# EasyEDA Pro project BCI_TESTING_BOARD.eprj, board BCI_Board (continued)
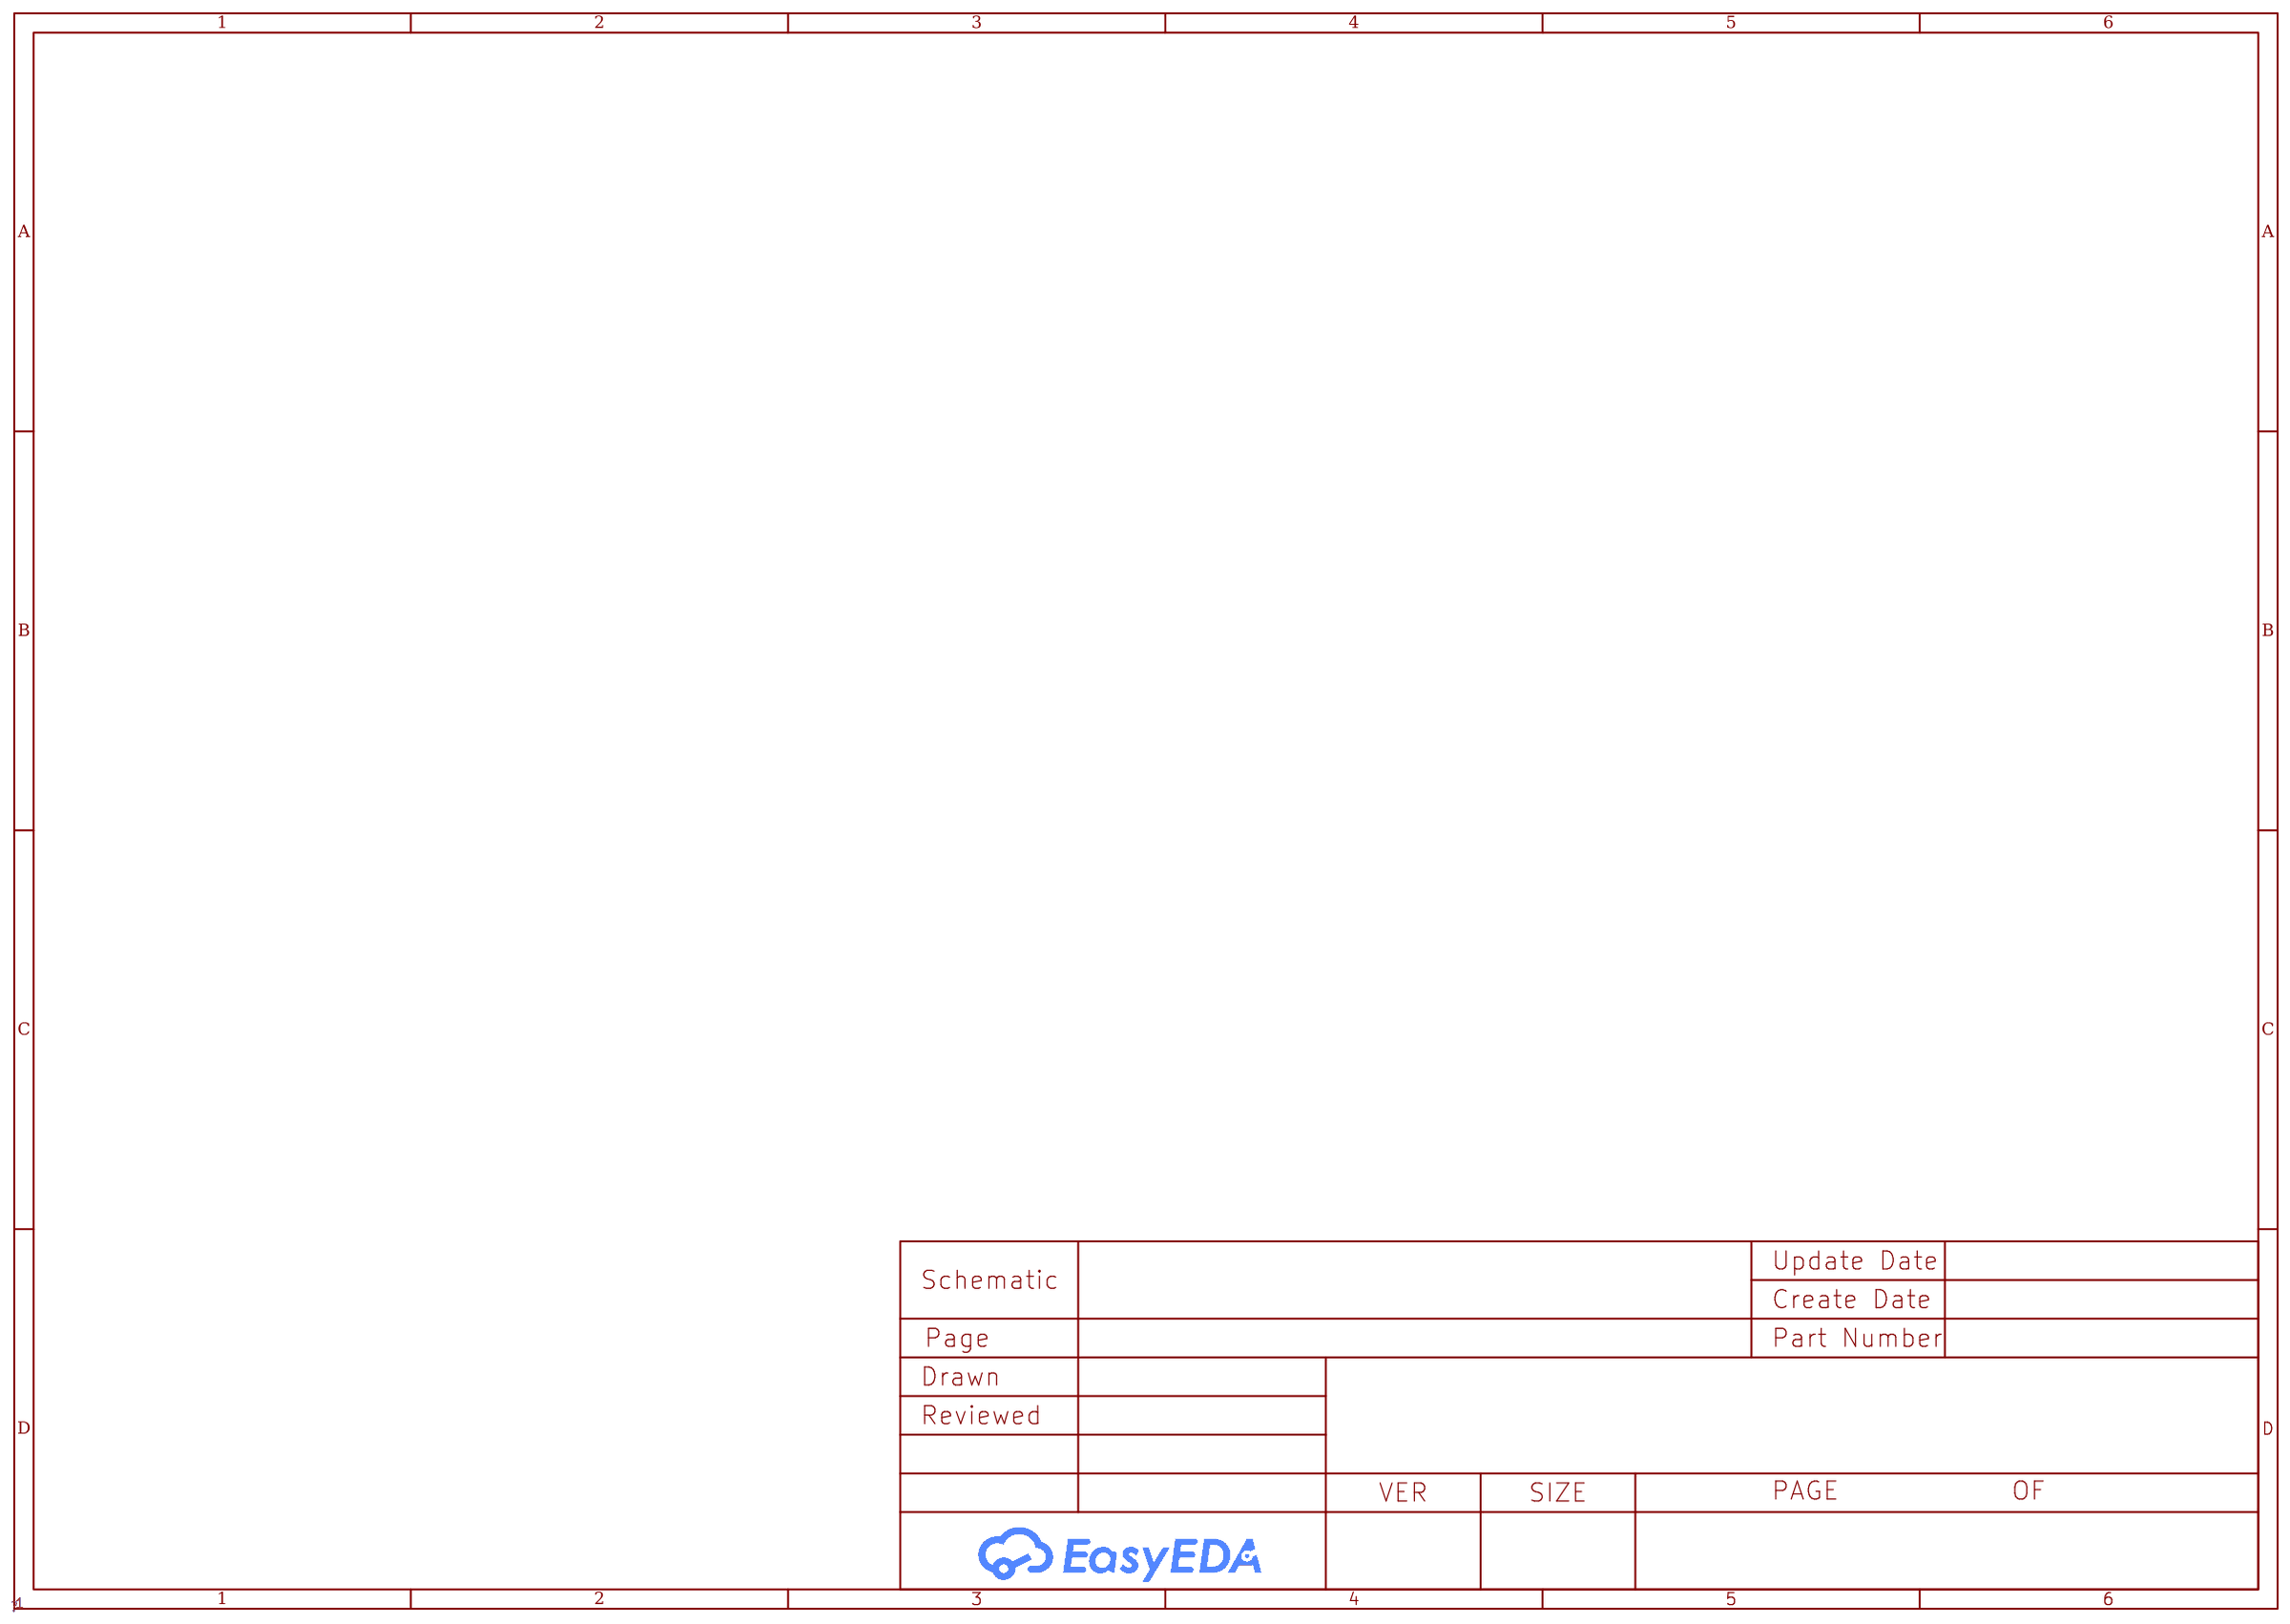
[diagram p0: ESP and Power]
## Routing (per net, layer and track width the routed paths; a pad name or vN(x,y) marks a point on that pad's centre or on a via; arc(x,y) is an arc through that point)
3V3: length 47.3
  Top Layer w0.2: v1(39.75,10.3) Rb1.1 C234.2 ; R1.1 v1(30.85,35.12) ; 30.21,39.55 30.21,38.6 30.06,38.45
  Top Layer w0.28: ADC2.50 24.55,16.72 25.17,16.1 ADC2.48 ; 25.17,37.6 ADC1.48 ; 25.17,37.6 24.55,38.22 ADC1.50 ; 25.17,37.6 24.17,37.6 23.55,38.22 ADC1.52
  Top Layer w0.8: C29.2 C222.1
  Inner2 w0.2: v1(38.8,4.45) 38.8,9.35 v1(39.75,10.3) ; v1(30.85,35.12) 30.32,35.65 28.6,35.65 28.4,35.45 26.9,35.45
  Inner2 w1.3: 27.05,38.25 26.75,37.95 26.75,16.3
  vias: v1(26.55,38.45) v1(26.6,16.95) v1(27.2,37.9) v1(27.2,16.4) v1(27.85,38.45) v1(27.85,16.95) v1(28.5,37.9) v1(38.8,3.45) v1(39.15,3.95) v1(39.5,4.45) v1(39.5,3.45)
5V: length 81.7
  Top Layer w0.28: ADC1.22 ADC1.21 19.55,29.3 19.3,29.55 18.8,29.55 18.55,29.3 ADC1.19 18.55,27.1 18.1,26.65 ; ADC2.22 ADC2.21 19.55,7.8 19.3,8.05 18.8,8.05 18.55,7.8 ADC2.19 18.55,5.6 C36.2 ; 22.9,19.55 22.9,19.35 22.55,19 ADC2.54 22.55,16.8 22.3,16.55 21.54,16.55 ; ADC2.56 21.55,16.56 21.54,16.55 ; ADC2.59 20.05,16.83 20.33,16.55 21.54,16.55 ; ADC1.56 21.55,38.05 ; 22.9,40.85 22.55,40.5 ADC1.54 22.55,38.38 22.22,38.05 20.38,38.05 20.05,38.38 ADC1.59
  Top Layer w0.8: 22.9,41.05 C26.2 v1(22.9,43.05) ; C25.2 C24.2 v1(18,24.55) ; v1(18,3.05) C40.2 18,5.05 ; 22.9,21.55 22.9,19.85
  Inner2 w2: v1(18,24.55) 19.82,22.73 21.72,22.73 v1(22.9,21.55) ; 18,3.6 18,5.85 22.9,10.75 v1(22.9,21.55) ; v1(22.9,21.55) 22.9,42.4
  vias: v1(26.4,5.75) v1(26.4,5.15) v1(26.95,5.45) v1(27.5,5.75) v1(27.5,5.15)
GND:
  vias: v1(0.6,44.15) v1(0.6,42.15) v1(0.6,40.15) v1(0.6,38.15) v1(0.6,36.15) v1(0.6,34.15) v1(0.6,32.15) v1(0.6,30.15) v1(0.6,28.15) v1(0.6,26.15) v1(0.6,24.15) v1(0.6,22.15) v1(0.6,20.15) v1(0.6,18.15) v1(0.6,16.15) v1(0.6,14.15) v1(0.6,12.15) v1(0.6,10.15) v1(0.6,8.15) v1(0.6,6.15) v1(0.6,4.15) v1(0.6,2.15) v1(3.4,45.8) v1(3.35,41.85) v1(3.35,40.15) v1(3.35,37.6) v1(3.35,35.05) v1(3.35,32.5) v1(3.35,30) v1(3.35,27.45) v1(3.35,24.9) v1(3.35,22.35) v1(3.35,19.8) v1(3.35,17.3) v1(3.35,14.75) v1(3.35,12.2) v1(3.35,9.65) v1(3.35,7.1) v1(3.35,4.55) v1(3.4,0.6) v1(5.4,45.8) v1(5.4,0.6) v1(5.7,44.15) v1(5.7,39.05) v1(5.7,18.75) v1(5.7,13.65) v1(5.7,8.6) v1(5.7,3.45) v1(5.75,33.95) v1(5.75,28.85) v1(5.8,23.85) v1(5.95,1.55) v1(6.1,41.9) v1(6.1,36.75) v1(6.1,31.75) v1(6.05,26.65) v1(6.05,21.5) v1(6.1,16.45) v1(6.1,11.45) v1(6.1,6.35) v1(6.2,24.5) v1(6.25,44.6) v1(6.25,39.8) v1(6.25,34.7) v1(6.25,29.6) v1(6.25,19.41) v1(6.25,14.3) v1(6.25,9.25) v1(6.25,4.4) v1(7.4,45.8) v1(7.4,0.6) v1(7.45,21.2) v1(7.45,15.95) v1(7.45,10.85) v1(7.45,5.75) v1(8,35.95) v1(8,25.95) v1(8.2,40.65) v1(8.3,30.85) v1(9.11,22.9) v1(9.11,20.95) v1(9.11,16.55) v1(9.11,11.6) v1(9.11,7.05) v1(9.1,1.65) v1(9.4,45.8) v1(9.4,0.6) v1(9.6,21.75) v1(10.3,33.85) v1(10.3,12.35) v1(10.4,44.8) v1(11.4,45.8) v1(11.4,0.6) v1(12.02,21.95) v1(12.4,44.8) v1(12.9,43.5) v1(12.9,42.4) v1(12.9,41.3) v1(12.9,40.2) v1(12.9,39.1) v1(12.9,38) v1(12.9,36.9) v1(12.9,35.8) v1(12.9,34.7) v1(12.9,33) v1(12.9,31.9) v1(12.9,30.8) v1(12.9,29.7) v1(12.9,28.6) v1(12.9,27.5) v1(12.9,26.4) v1(12.9,25.3) v1(12.9,24.2) v1(12.9,23.1) v1(12.9,20.9) v1(12.9,19.8) v1(12.9,18.7) v1(12.9,17.6) v1(12.9,16.5) v1(12.9,15.4) v1(12.9,14.3) v1(12.9,13.2) v1(12.9,11.5) v1(12.9,10.4) v1(12.9,9.3) v1(12.9,8.2) v1(12.9,7.1) v1(12.9,6) v1(12.9,4.9) v1(12.9,3.8) v1(12.9,2.7) v1(12.9,1.6) v1(13.4,45.8) v1(13.4,44.15) v1(13.4,0.6) v1(13.85,21.95) v1(14.4,44.8) v1(14.4,42.8) v1(14.4,3.6) v1(14.4,1.6) v1(14.75,25.75) v1(14.75,23.95) v1(14.92,28.1) v1(14.95,39.2) v1(15,29.45) v1(14.95,17.7) v1(15,7.95) v1(14.95,6.6) v1(15.05,22.1) v1(15.2,20.55) v1(15.4,45.8) v1(15.4,43.8) v1(15.4,4.6) v1(15.4,2.6) v1(15.4,0.6) v1(15.95,40.2) v1(15.95,38.2) v1(15.95,18.7) v1(15.95,16.7) v1(16.3,4.4) v1(16.3,3.1) v1(16.4,44.8) v1(16.4,42.8) v1(16.4,1.6) v1(16.45,20.7) v1(16.7,23.85) v1(16.9,27.2) v1(16.9,25.9) v1(16.91,18.45) v1(16.95,39.2) v1(16.95,17.7) v1(17.15,38.05) v1(17.15,35.85) v1(17.15,33.85) v1(17.15,31.85) v1(17.4,45.8) v1(17.4,43.8) v1(17.35,22.75) v1(17.35,8.85) v1(17.4,2.25) v1(17.4,0.6) v1(17.7,16.05) v1(17.7,13.55) v1(17.7,11.35) v1(17.85,19.3) v1(18,43.2) v1(18.25,30) v1(18.4,44.8) v1(18.4,21.7) v1(18.4,1.6) v1(18.9,42.35) v1(18.95,25.9) v1(18.95,9.1) v1(19.05,37.05) v1(19.05,35.5) v1(19.05,33.95) v1(19.05,32.15) v1(19.4,45.8) v1(19.4,43.8) v1(19.4,16.5) v1(19.4,2.3) v1(19.4,0.6) v1(19.45,38.1) v1(19.65,42.35) v1(19.65,41.05) v1(19.7,25.9) v1(19.65,20.85) v1(19.65,19.55) v1(19.7,4.4) v1(19.7,3.1) v1(19.9,30.8) v1(20,10.15) v1(20.4,44.8) v1(20.4,1.6) v1(20.55,29.6) v1(20.6,24.25) v1(20.75,43.05) v1(20.75,41.7) v1(20.75,20.2) v1(20.9,15.65) v1(20.9,13.3) v1(20.9,11.05) v1(21.4,45.8) v1(21.4,43.8) v1(21.35,37.15) v1(21.35,35.75) v1(21.35,34.35) v1(21.35,32.95) v1(21.35,31.45) v1(21.4,29.75) v1(21.4,24.25) v1(21.4,2.3) v1(21.4,0.6) v1(21.55,3.05) v1(22.4,44.8) v1(22.35,3.05) v1(22.4,1.6) v1(23,8.65) v1(23.4,43.8) v1(23.4,0.6) v1(23.85,9.4) v1(23.9,8.3) v1(24.25,42.95) v1(24.35,41.7) v1(24.35,10.35) v1(24.5,30.55) v1(24.6,29.55) v1(24.55,15.25) v1(24.55,13.1) v1(24.8,8.05) v1(24.9,41.05) v1(25,31.75) v1(25,20.85) v1(25,19.55) v1(24.95,4.35) v1(25.1,36.75) v1(25.1,34.85) v1(25.1,33.05) v1(25.4,41.8) v1(25.4,12.6) v1(25.4,2.85) v1(25.4,1.35) v1(25.4,0.6) v1(25.5,39.65) v1(25.5,38.45) v1(25.5,18.25) v1(25.5,16.95) v1(25.45,11.5) v1(25.45,6.75) v1(25.6,28.45) v1(25.6,27.25) v1(25.6,25.85) v1(25.6,24.35) v1(25.6,22.85) v1(25.55,8.35) v1(25.55,7.55) v1(25.65,4.35) v1(26.2,6.75) v1(26.4,40.8) v1(26.35,4.35) v1(26.6,39.85) v1(27.1,4.35) v1(27.4,0.6) v1(27.75,3.85) v1(27.75,3.25) v1(27.75,2.55) v1(27.75,1.9) v1(27.75,1.25) v1(27.85,39.85) v1(27.85,29.75) v1(27.85,28.7) v1(27.85,25.85) v1(27.85,24.35) v1(27.85,22.85) v1(27.85,21.45) v1(27.85,20.1) v1(27.85,18.95) v1(27.85,18) v1(28.1,6.4) v1(28.25,36.1) v1(28.25,14.6) v1(28.4,9.55) v1(28.45,3.55) v1(28.45,2.9) v1(28.45,2.25) v1(28.45,1.6) v1(28.45,0.95) v1(28.55,31.15) v1(28.55,18.95) v1(28.65,28.85) v1(28.7,6.4) v1(28.75,35) v1(28.75,13.5) v1(29,27.85) v1(29.2,37.05) v1(29.3,6.4) v1(29.35,39.4) v1(29.4,15.75) v1(29.4,0.6) v1(29.45,28.35) v1(29.45,26.7) v1(29.45,24.15) v1(29.45,22.1) v1(29.45,20.1) v1(29.7,35.1) v1(29.7,33.4) v1(29.65,14.4) v1(29.7,5.85) v1(29.7,5.2) v1(29.75,31.7) v1(29.9,13.05) v1(29.85,9.95) v1(29.85,1.05) v1(30.3,5.5) v1(30.4,34.55) v1(30.35,32.7) v1(30.45,37.05) v1(30.55,30.3) v1(30.55,28.7) v1(30.55,26.65) v1(30.55,24.15) v1(30.55,22.1) v1(30.55,20.1) v1(30.55,18.35) v1(30.55,16.75) v1(30.55,15.3) v1(30.9,5.85) v1(30.9,5.15) v1(30.9,1.2) v1(30.95,11.05) v1(31.4,0.6) v1(31.5,5.5) v1(31.7,37.05) v1(31.65,32.95) v1(31.65,31.7) v1(31.65,30.8) v1(31.65,29.2) v1(31.65,27.95) v1(31.65,26.25) v1(31.65,24.15) v1(31.65,22.1) v1(31.65,20.1) v1(31.65,18.35) v1(31.65,16.75) v1(31.65,14.8) v1(31.65,13.05) v1(32.1,5.85) v1(32.1,5.2) v1(32.2,1.05) v1(32.4,10.4) v1(32.5,6.4) v1(32.75,29.05) v1(32.75,27.35) v1(32.75,25.75) v1(32.75,24.15) v1(32.75,22.1) v1(32.75,20.1) v1(32.75,18.35) v1(32.75,16.75) v1(32.75,14.2) v1(33.1,6.4) v1(33.15,40.25) v1(33.25,38.7) v1(33.35,7.55) v1(33.35,3.45) v1(33.35,2.35) v1(33.35,1.35) v1(33.4,0.6) v1(33.5,37.55) v1(33.45,34.1) v1(33.45,31.7) v1(33.6,11.6) v1(33.85,35.95) v1(34,34.75) v1(34.2,27.2) v1(34.2,26.3) v1(34.2,23.25) v1(34.2,21) v1(34.2,15.8) v1(34.2,14.1) v1(34.2,12.7) v1(34.15,10.43) v1(34.35,28.95) v1(34.4,3.45) v1(34.4,1.6) v1(34.45,2.65) v1(34.55,34.2) v1(34.9,27.9) v1(34.9,26.9) v1(35.05,31.7) v1(35.05,20.98) v1(35.15,15.8) v1(35.3,4.2) v1(35.35,23.4) v1(35.35,21.55) v1(35.4,2.6) v1(35.5,38.35) v1(35.5,36.35) v1(35.5,34.35) v1(35.5,32.95) v1(35.65,40.25) v1(35.7,22.8) v1(35.65,11.9) v1(36,23.35) v1(36,5) v1(36.05,15.8) v1(36.25,31.7) v1(36.4,2.6) v1(36.6,23.25) v1(36.55,12.8) v1(36.7,8.55) v1(36.8,26.65) v1(36.85,4.15) v1(37.4,28.95) v1(37.4,28.3) v1(37.4,2.6) v1(37.45,38.35) v1(37.45,36.35) v1(37.45,34.35) v1(37.45,32.5) v1(37.65,31.7) v1(37.65,3.35) v1(38.1,40.25) v1(38.17,8.65) v1(38.15,7.05) v1(38.4,2.6) v1(38.93,15.35) v1(39,10.6) v1(39.05,31.7) v1(39.08,13.45) v1(39.4,6.35) v1(39.4,2.6) v1(39.45,38.35) v1(39.45,36.35) v1(39.45,34.35) v1(39.45,33.25) v1(39.45,8.95) v1(39.5,5.7) v1(39.65,6.95) v1(39.8,29.2) v1(39.93,13.45) v1(39.9,5.2) v1(40.25,32.1) v1(40.3,2.6) v1(40.45,40.25) v1(40.8,6.95) v1(40.8,5.2) v1(41.1,6.3) v1(41.2,28.45) v1(41.25,17.75) v1(41.4,2.6) v1(41.45,38.35) v1(41.45,36.35) v1(41.45,34.35) v1(41.45,33.25) v1(41.5,32.15) v1(41.5,20.5) v1(41.7,9.8) v1(41.7,8.25) v1(41.7,5.2) v1(41.8,9.1) v1(42.3,8.61) v1(42.5,2.6) v1(42.7,13.9) v1(42.7,13.15) v1(42.9,37.7) v1(42.9,35.8) v1(42.9,32.9) v1(43.2,39.05) v1(43.21,31.5) v1(43.15,26.3) v1(43.5,34.05) v1(43.45,17.8) v1(43.6,2.6) v1(43.65,11.5) v1(43.75,40.25) v1(44.1,11) v1(44.2,29.2) v1(44.7,29.9) v1(44.7,26.3) v1(44.7,24.3) v1(44.7,22.3) v1(44.7,20.3) v1(44.7,17) v1(44.7,15) v1(44.7,13) v1(44.7,11) v1(44.7,9.55) v1(44.7,8.45) v1(44.7,7.35) v1(44.7,5.1) v1(44.65,2.65)
VIN: length 21.6
  Top Layer w0.2: 41.58,7.45 41.15,7.45 40.65,7.95 U14.1 ; 31.9,6.66 31.9,6.85 v1(32.15,7.1) 32.65,7.6 32.65,7.75 ; v1(42.24,20.39) 43.45,21.6 43.45,25.15 42,26.6 R_adc2.2
  Inner2 w0.2: v1(42.24,20.39) 41.84,19.99 v1(41.84,13.25) ; v1(32.15,7.1) 32.3,6.95 33.35,6.95 34.15,6.15 v1(34.15,6.1)
  vias: v1(40.94,13.25) v1(40.94,12.45) v1(41.39,12.85) v1(41.84,12.45) v1(43.25,8.2) v1(43.25,7.6) v1(43.85,8.8) v1(43.85,8.2) v1(43.85,7.6)
(no net): length 0.5
  Top Layer w0.25: ADC2.62 ADC2.63
ADC: length 11.1
  Top Layer w0.2: v1(38.45,32.1) U2.18
  Top Layer w0.5: C_adc.1 R_adc2.1 R_adc1.1 ; v1(42,29.58) 42,29.2
  Bottom Layer w0.2: v1(42,29.58) 42.65,30.23 42.65,31.85 41.8,32.7 40.65,32.7 NOREF#33.TP2 40.2,32.7 39.05,32.7 v1(38.45,32.1)
B: length 18.2
  Top Layer w0.2: 29.75,40.4 30,40.15 v1(30.3,40.15) ; U2.30 v1(43.45,35.35)
  Bottom Layer w0.2: v1(30.3,40.15) 31.15,39.3 NOREF#34.TP2 42.1,39.3 43.45,37.95 v1(43.45,35.35)
BIAS_DRV: length 6.7
  Top Layer w0.2: 11.45,43.5 11.55,43.4 11.55,43.2 11.81,42.95 13.12,42.95 15.19,40.88 15.27,40.88
  Top Layer w0.3: Cbias3.1 RBIAS4.2
  Top Layer w0.4: RBIAS5.2 CBIAS1.2
BIASINV: length 30.7
  Top Layer w0.28: RBIAS1.2 18.3,41.85 19.05,41.1 ADC1.61 ; ADC2.61 19.05,19.25 v1(18.75,19.55)
  Top Layer w0.5: 17.4,41.85 17.93,41.85
  Top Layer w0.54: v1(18.05,42.35) 18.05,41.95
  Inner2 w0.8: v1(18.05,42.35) 18.05,31.3 15.8,29.05 15.8,22.7 18.75,19.75 v1(18.75,19.55)
CLK: length 26.3
  Top Layer w0.2: 28.2,10.35 27.95,10.6 ADC2.37 ; v1(29.05,31.65) 28.6,32.1 ADC1.37
  Bottom Layer w0.2: v1(29.05,31.65) 30,30.7 30,15.55 28.2,13.75 NOREF#35.TP2
  vias: v1(28.2,10.35)
CSEL1: length 11.4
  Top Layer w0.2: v1(29,33.15) 28.95,33.1 ADC1.39 ; U2.13 v1(34.45,33.4)
  Inner2 w0.2: v1(34.45,33.4) 34.33,33.52 31.88,33.52 31.4,34 29.5,34 29,33.5 v1(29,33.15)
CSEL2: length 28.5
  Top Layer w0.2: U2.19 39.25,30.05 38.7,29.5 35.7,29.5 v1(35.19,28.99) 32.2,26 32.2,12.5 31.3,11.6 26.7,11.6
DN: length 18.2
  Top Layer w0.2: v1(43.45,32.45) 43.75,32.15 U2.26 ; USB1.5 41.2,22.6 v1(41.45,22.35) 42.1,22.35 42.4,22.65 42.4,23.4 42.1,23.7 v1(41.8,23.7) 41.7,23.6 USB1.7
  Bottom Layer w0.2: v1(41.8,23.7) 42.2,24.1 42.2,25.15 NOREF#26.TP2 42.2,25.85 42.2,28.46 43.77,30.04 43.77,31.51 43.78,31.51 43.78,32.12 v1(43.45,32.45)
DP: length 22.1
  Top Layer w0.2: U2.27 43.85,32.95 v1(43.45,33.35) ; USB1.8 41.2,24.1 v1(41.45,24.35) ; USB1.6 41.7,23.1 41.8,23
  Inner2 w0.2: v1(41.8,23) 42.15,23 42.4,23.25 42.4,24.1 42.15,24.35 v1(41.45,24.35)
  Bottom Layer w0.2: v1(43.45,33.35) 43.45,33.35 44.1,32.7 44.1,29.9 42.53,28.33 42.53,23.73 v1(41.8,23) 42.5,23 NOREF#41.TP2
G: length 6.5
  Top Layer w0.2: 38.7,28.55 38.25,28.55
  Inner2 w0.2: v1(38.7,28.55) 38.28,28.13 38.28,27.42 38.08,27.22 36.57,27.22 35.57,26.22 v1(35.57,24.67)
IN1N: length 8.1
  Top Layer w0.2: ADC1.15 14.76,30.6 14.03,29.87 14.03,27.92 13.06,26.95 11.7,26.95 11.45,26.7 11.45,26.4
  Top Layer w0.4: C102.2 R102.2
IN1N1: length 8.2
  Top Layer w0.2: 11.45,4.9 11.45,5.2 11.67,5.42 13.13,5.42 14.03,6.33 14.03,8.37 14.76,9.1 ADC2.15
  Top Layer w0.4: C202.2 R202.2
IN1P: length 8.7
  Top Layer w0.2: ADC1.16 14.72,30.1 14.36,29.73 14.36,27.15 13.09,25.88 11.73,25.88 11.45,25.6 11.45,25.3
  Top Layer w0.4: R101.2 C101.1
IN1P1: length 8.7
  Top Layer w0.2: 11.45,3.8 11.45,4.1 11.67,4.32 13.03,4.32 14.36,5.65 14.36,8.23 14.72,8.6 ADC2.16
  Top Layer w0.4: C201.1 R201.2
IN2N: length 7.2
  Top Layer w0.2: 11.45,28.6 11.45,28.9 11.7,29.15 13.06,29.15 13.38,29.47 13.38,30.14 14.84,31.6 16.05,31.6
  Top Layer w0.4: R104.2 C104.2
IN2N1: length 6.9
  Top Layer w0.2: ADC2.13 14.84,10.1 13.38,8.64 13.38,7.97 13.06,7.65 11.7,7.65 11.45,7.4 11.45,7.1
  Top Layer w0.4: C204.2 R204.2
IN2P: length 7.5
  Top Layer w0.2: ADC1.14 14.8,31.1 13.7,30 13.7,28.69 13.06,28.05 11.7,28.05 11.45,27.8 11.45,27.5
  Top Layer w0.4: R103.2 C103.1
IN2P1: length 7.5
  Top Layer w0.2: 11.45,6 11.45,6.3 11.7,6.55 13.06,6.55 13.7,7.19 13.7,8.5 14.8,9.6 ADC2.14
  Top Layer w0.4: R203.2 C203.1
IN3N: length 6.6
  Top Layer w0.2: 11.45,30.8 11.45,31.1 11.7,31.35 13.02,31.35 14.27,32.6 16.35,32.6
  Top Layer w0.4: R106.2 C106.2
IN3N1: length 6
  Top Layer w0.2: ADC2.11 14.28,11.1 13.02,9.85 11.7,9.85 11.45,9.6 11.45,9.3
  Top Layer w0.4: C206.2 R206.2
IN3P: length 6.8
  Top Layer w0.2: 16.35,32.1 14.87,32.1 13.02,30.25 11.7,30.25 11.45,30 11.45,29.7
  Top Layer w0.4: R105.2 C105.1
IN3P1: length 5.4
  Top Layer w0.2: 11.45,8.2 11.45,8.5 11.7,8.75 13.02,8.75 14.87,10.6 14.91,10.6
  Top Layer w0.4: C205.1 R205.2
IN4N: length 6.1
  Top Layer w0.2: 16.35,33.6 11.75,33.6 11.45,33.3 11.45,33
  Top Layer w0.4: R108.2 C108.2
IN4N1: length 5.5
  Top Layer w0.2: 11.45,11.5 11.45,11.8 11.75,12.1 ADC2.9
  Top Layer w0.4: R208.2 C208.2
IN4P: length 6.3
  Top Layer w0.2: 16.35,33.1 13.67,33.1 13.02,32.45 11.7,32.45 11.45,32.2 11.45,31.9
  Top Layer w0.4: R107.2 C107.1
IN4P1: length 5.7
  Top Layer w0.2: ADC2.10 13.67,11.6 13.02,10.95 11.7,10.95 11.45,10.7 11.45,10.4
  Top Layer w0.4: R207.2 C207.1
IN5N: length 5
  Top Layer w0.2: 11.45,35.8 11.45,35.5 11.7,35.25 13.02,35.25 13.67,34.6 14.97,34.6
  Top Layer w0.4: R110.2 C110.2
IN5N1: length 5.7
  Top Layer w0.2: 11.45,14.3 11.45,14 11.7,13.75 13.02,13.75 13.67,13.1 ADC2.7
  Top Layer w0.4: R210.2 C210.2
IN5P: length 6.1
  Top Layer w0.2: 11.45,34.7 11.45,34.4 11.75,34.1 16.35,34.1
  Top Layer w0.4: C109.1 R109.2
IN5P1: length 5.5
  Top Layer w0.2: 11.45,13.2 11.45,12.9 11.75,12.6 ADC2.8
  Top Layer w0.4: C209.1 R209.2
IN6N: length 6.2
  Top Layer w0.2: ADC1.5 15.74,35.61 14.87,35.61 13.02,37.45 11.7,37.45 11.45,37.7 11.45,38
  Top Layer w0.4: R112.2 C112.2
IN6N1: length 6.2
  Top Layer w0.2: 11.45,16.5 11.45,16.2 11.7,15.95 13.02,15.95 14.87,14.1 ADC2.5
  Top Layer w0.4: R212.2 C212.2
IN6P: length 5.2
  Top Layer w0.2: 11.45,36.9 11.45,36.6 11.7,36.35 13.02,36.35 14.27,35.1 14.97,35.1
  Top Layer w0.4: C111.1 R111.2
IN6P1: length 6
  Top Layer w0.2: ADC2.6 14.28,13.6 13.02,14.85 11.7,14.85 11.45,15.1 11.45,15.4
  Top Layer w0.4: R211.2 C211.1
IN7N: length 7.5
  Top Layer w0.2: ADC1.3 14.8,36.6 13.7,37.7 13.7,38.97 13.02,39.65 11.7,39.65 11.45,39.9 11.45,40.2
  Top Layer w0.4: R114.2 C114.2
IN7N1: length 7.5
  Top Layer w0.2: ADC2.3 14.8,15.1 13.7,16.2 13.7,17.51 13.06,18.15 11.7,18.15 11.45,18.4 11.45,18.7
  Top Layer w0.4: C214.2 R214.2
IN7P: length 6.9
  Top Layer w0.2: ADC1.4 14.84,36.1 13.38,37.56 13.38,38.2 13.02,38.55 11.7,38.55 11.45,38.8 11.45,39.1
  Top Layer w0.4: C113.1 R113.2
IN7P1: length 6.9
  Top Layer w0.2: ADC2.4 14.84,14.6 13.38,16.06 13.38,16.73 13.06,17.05 11.7,17.05 11.45,17.3 11.45,17.6
  Top Layer w0.4: C213.1 R213.2
IN8N: length 8.7
  Top Layer w0.2: 11.45,42.4 11.45,42.1 11.7,41.85 13.06,41.85 14.36,40.55 14.36,37.97 14.72,37.6 ADC1.1
  Top Layer w0.4: C116.2 R116.2
IN8N1: length 8.7
  Top Layer w0.2: ADC2.1 14.72,16.1 14.36,16.47 14.36,19.05 13.06,20.35 11.7,20.35 11.45,20.6 11.45,20.9
  Top Layer w0.4: C216.2 R216.2
IN8P: length 8.1
  Top Layer w0.2: 11.45,41.3 11.45,41 11.7,40.75 13.02,40.75 14.03,39.74 14.03,37.83 14.76,37.1 ADC1.2
  Top Layer w0.4: R115.2 C115.1
IN8P1: length 8.1
  Top Layer w0.2: ADC2.2 14.76,15.6 14.03,16.33 14.03,18.24 13.05,19.22 11.73,19.22 11.45,19.5 11.45,19.8
  Top Layer w0.4: R215.2 C215.1
INT: length 8.2
  Top Layer w0.2: v1(33.45,35.35) 32.55,35.35 ; ADC1.47 27.95,37.1 v1(28.25,36.8)
  Bottom Layer w0.2: v1(33.45,35.35) 32.45,36.35 28.85,36.35 28.4,36.8 v1(28.25,36.8)
MISO: length 9
  Top Layer w0.2: ADC1.43 28.05,35.1 29.1,36.15 33.15,36.15 v1(33.75,36.75)
  Bottom Layer w0.2: v1(33.75,36.75) 34.35,37.35 NOREF#10.TP2
MOSI: length 40.2
  Top Layer w0.2: ADC2.34 27.95,9.1 v1(28.2,8.85) ; v1(39.75,31.55) 40.05,31.25 40.05,30.45 ; ADC1.34 29.45,30.6 31.45,28.6 v1(32.2,28.6) ; 26.45,9.1 26.48,9.13
  Bottom Layer w0.2: 28.21,8.83 28.49,8.83 29.3,9.64 29.3,11.65 32.2,14.55 v1(32.2,28.6) 32.2,30.1 32.75,30.65 33.2,31.1 39.35,31.1 39.75,31.5 v1(39.75,31.55)
PBIAS: length 9.5
  Top Layer w0.2: RBIAS5.1 8.65,43.5 7.95,44.2 D5.1 7.95,44.97 7.67,45.25 4.57,45.25 4.57,44.79
  Top Layer w1: 4.57,44.79 2.03,44.79
PIN1N: length 10
  Top Layer w0.2: R102.1 9.87,26.37 7.95,24.45 ; 7.95,24.45 D1.1 ; 7.95,24.45 7.95,24.5 6.7,25.75 3.31,25.75 2.03,24.47
PIN1N1: length 10.1
  Top Layer w0.2: 2.03,1.66 3.22,2.85 6.9,2.85 7.3,2.45 ; D7.5 7.3,2.45 ; 7.3,2.45 7.7,2.85 8.4,2.85 9.15,3.6 9.15,4.18 R202.1
PIN1P: length 7.8
  Top Layer w0.2: 4.57,24.47 5.25,25.15 6.7,25.15 7.3,24.55 D1.2 7.3,23.75 7.57,23.48 8.2,23.48 8.4,23.68 8.4,24.12 9.58,25.3 R101.1
PIN1P1: length 7.6
  Top Layer w0.2: 4.57,1.61 4.57,1.66 5.08,2.17 D7.4 6.65,1.65 6.85,1.45 8.3,1.45 8.5,1.65 8.5,2.48 9.82,3.8
PIN2N: length 9.1
  Top Layer w0.2: 7.3,27.85 6.9,28.25 3.27,28.25 2.03,27.01 ; 7.3,27.85 D2.5 ; 7.3,27.85 7.76,28.31 9.57,28.31 R104.1
PIN2N1: length 11.6
  Top Layer w0.2: R204.1 9.87,7.02 9.32,6.47 9.32,6.19 8.88,5.75 8.6,5.75 8.28,5.43 8.28,4.18 D7.1 7.95,4.3 6.8,5.45 3.33,5.45 2.03,4.15
PIN2P: length 6.8
  Top Layer w0.2: 4.57,27.01 4.57,27.62 4.6,27.65 6.71,27.65 ; R103.1 9.22,26.85 7,26.85 6.65,27.2 D2.4
PIN2P1: length 8.8
  Top Layer w0.2: 4.57,4.15 5.47,5.05 6.5,5.05 7.3,4.25 D7.2 7.3,3.37 7.44,3.23 8.32,3.23 8.7,3.61 8.7,4.83 R203.1
PIN3N: length 9.9
  Top Layer w0.2: 7.95,29.4 7.95,29.74 6.84,30.85 3.33,30.85 2.03,29.55 ; 7.95,29.4 8.47,29.4 R106.1 ; 7.95,29.4 D2.1
PIN3N1: length 9.5
  Top Layer w0.2: 2.03,6.69 3.29,7.95 6.9,7.95 7.3,7.55 ; 7.3,7.55 7.7,7.95 8.52,7.95 R206.1 ; 7.3,7.55 D8.5
PIN3P: length 7.6
  Top Layer w0.2: 4.57,29.55 4.57,30.25 6.8,30.25 7.3,29.75 D2.2 7.3,28.85 7.52,28.63 8.8,28.63 R105.1
PIN3P1: length 7.2
  Top Layer w0.2: 4.57,6.74 4.57,6.94 4.98,7.35 6.61,7.35 ; R205.1 9.4,8.2 8.5,7.3 8.5,6.75 8.3,6.55 6.9,6.55 6.65,6.8 D8.4
PIN4N: length 9.1
  Top Layer w0.2: D3.5 7.3,32.93 ; 7.3,32.93 7.3,32.95 6.9,33.35 3.29,33.35 2.03,32.09 ; 7.3,32.93 7.72,33.35 8.6,33.35 8.95,33 R108.1
PIN4N1: length 10.7
  Top Layer w0.2: 7.95,9 7.95,9.44 6.89,10.5 3.3,10.5 2.03,9.23 ; 7.95,9 8.3,9.35 8.3,9.93 R208.1 ; 7.95,9 D8.1
PIN4P: length 6.7
  Top Layer w0.2: 4.57,32.09 4.57,32.82 4.6,32.85 6.41,32.85 6.65,32.61 6.65,32.2 6.95,31.9 R107.1
PIN4P1: length 8
  Top Layer w0.2: 4.57,9.28 5.19,9.9 6.9,9.9 7.3,9.5 D8.2 7.3,8.51 7.5,8.31 8.36,8.31 8.85,8.8 8.85,9.38 R207.1
PIN5N: length 9.6
  Top Layer w0.2: 7.95,34.7 6.8,35.85 3.25,35.85 2.03,34.63 ; 7.95,34.7 9.05,35.8 R110.1 ; 7.95,34.7 D3.1
PIN5N1: length 9.5
  Top Layer w0.2: D9.5 7.3,12.65 ; 7.3,12.65 6.9,13.05 3.31,13.05 2.03,11.77 ; 7.3,12.65 7.67,13.02 8.39,13.02 9.67,14.3 R210.1
PIN5P: length 7.5
  Top Layer w0.2: 4.57,34.63 4.57,35.12 4.8,35.35 6.8,35.35 7.3,34.85 D3.2 7.3,33.95 7.54,33.71 8.26,33.71 9.25,34.7 R109.1
PIN5P1: length 6.9
  Top Layer w0.2: 4.57,11.82 4.57,12.06 4.96,12.45 6.71,12.45 ; D9.4 6.65,11.9 6.9,11.65 8.3,11.65 9.85,13.2 R209.1
PIN6N: length 9.2
  Top Layer w0.2: 7.3,38.15 7.4,38.15 7.7,38.45 8.2,38.45 8.65,38 R112.1 ; 7.3,38.15 7.2,38.15 6.9,38.45 3.31,38.45 2.03,37.17 ; 7.3,38.15 D4.5
PIN6N1: length 10.5
  Top Layer w0.2: R212.1 8.2,14.83 8.2,14.45 7.95,14.2 D9.1 7.93,14.03 7.93,14.32 6.7,15.55 3.27,15.55 2.03,14.31
PIN6P: length 6.3
  Top Layer w0.2: 4.57,37.17 4.72,37.17 5.4,37.85 6.71,37.85 ; R111.1 7,36.9 6.65,37.25 D4.4
PIN6P1: length 8.1
  Top Layer w0.2: 4.57,14.36 4.57,14.82 4.7,14.95 6.8,14.95 7.3,14.45 D9.2 7.3,13.55 7.5,13.35 8.25,13.35 8.55,13.65 8.55,14.08 R211.1
PIN7N: length 9.6
  Top Layer w0.2: 2.03,39.71 3.27,40.95 6.95,40.95 7.95,39.95 D4.1 8.74,40.2 R114.1
PIN7N1: length 9.6
  Top Layer w0.2: 2.03,16.85 3.33,18.15 6.84,18.15 7.29,17.7 7.29,17.42 D10.5 7.3,17.75 7.6,18.05 9.22,18.05 R214.1
PIN7P: length 7
  Top Layer w0.2: R113.1 8.55,39.1 8.24,38.79 7.46,38.79 7.3,38.95 D4.2 7.3,39.95 6.8,40.45 5.31,40.45 4.57,39.71
PIN7P1: length 6.4
  Top Layer w0.2: 4.57,16.9 5.08,17.41 D10.4 6.65,17 6.9,16.75 8.45,16.75 9.3,17.6 R213.1
PIN8N: length 9.6
  Top Layer w0.2: 2.03,42.25 2.08,42.2 2.35,42.2 3.65,43.5 7.05,43.5 7.3,43.25 D5.5 7.3,42.35 7.55,42.1 8.35,42.1 8.65,42.4 R116.1
PIN8N1: length 10
  Top Layer w0.2: 7.95,19.3 8.27,19.3 R216.1 ; 7.95,19.3 7.95,19.09 ; 7.95,19.3 7.95,19.66 6.96,20.65 3.29,20.65 2.03,19.39
PIN8P: length 6.3
  Top Layer w0.2: 4.57,42.25 4.7,42.25 5.3,42.85 6.41,42.85 6.61,42.65 6.61,42.44 7.75,41.3 R115.1
PIN8P1: length 7.4
  Top Layer w0.2: 4.57,19.44 5.18,20.05 6.89,20.05 7.3,19.64 7.3,18.65 7.5,18.45 8.52,18.45 R215.1
PINSRB1: length 30.5
  Top Layer w0.2: 9.87,22.92 8.8,21.85 7.01,21.85 6.65,22.21 D1.4 6.59,22.55 4.99,22.55 4.57,22.13 4.57,21.93
  Top Layer w0.54: v1(10.02,1.1) 9.87,1.26 Rsrb21.1 ; Rsrb11.1 9.87,22.58 10.25,22.2 v1(10.87,22.2)
  Inner2 w0.7: v1(10.02,1.1) 11.17,2.25 11.17,21.9 v1(10.87,22.2)
PINSRB2: length 34.8
  Top Layer w0.2: D1.5 7.3,22.85 ; 7.3,22.85 7.4,22.85 7.7,23.15 8.35,23.15 v1(9.4,24.2) ; 7.3,22.85 7.2,22.85 6.85,23.2 3.3,23.2 2.03,21.93
  Top Layer w0.54: v1(9.4,24.2) Rsrb12.1 ; Rsrb22.1 9.6,2.7 v1(9.35,2.45)
  Inner2 w0.7: v1(9.35,2.45) 8.3,3.5 8.3,23.3 9.2,24.2 v1(9.4,24.2)
  Bottom Layer w0.2: v1(9.4,24.2) NOREF.TP2
PWDN: length 68.9
  Top Layer w0.2: ADC1.35 25.91,31.1 25.6,30.79 25.6,29.88 27.73,27.75 28.27,27.75 v1(28.3,27.78) ; 41.65,30.45 v1(41.65,31.45) ; ADC2.35 25.81,9.6 25.36,9.15 v1(24.65,9.15)
  Bottom Layer w0.2: 33.63,12.46 33.63,29.03 34.35,29.75 39.91,29.75 41.61,31.45 v1(41.65,31.45) ; 33.63,12.46 34.74,11.35 NOREF#18.TP2 ; 33.63,12.46 28.74,7.57 27.33,7.57 25.95,8.95 24.85,8.95 v1(24.65,9.15) 24.65,9.82 26.87,12.04 26.87,14.49 29.1,16.71 29.1,19.2 28.5,19.8 28.5,26.75 28.3,26.95 v1(28.3,27.78)
R: length 7.9
  Top Layer w0.2: LED1.1 38,27.7 v1(37.8,27.7)
  Inner2 w0.2: v1(37.8,27.7) 36.59,27.7 34.8,25.91 34.8,22.53 v1(34.62,22.35)
RESET: length 66.8
  Top Layer w0.2: v1(25.15,9.65) 25.6,10.1 ADC2.36 ; v1(40.95,31.7) 40.85,31.6 U2.21 ; v1(28.9,27.15) 27.87,27.15 25.27,29.75 25.27,30.92 25.95,31.6 ADC1.36
  Bottom Layer w0.2: v1(28.9,27.15) 28.88,27.13 28.88,19.89 29.43,19.34 29.43,16.58 27.2,14.35 27.2,11.91 25.15,9.86 v1(25.15,9.65) 25.53,9.27 26.09,9.27 27.46,7.9 28.6,7.9 32.55,11.85 NOREF#31.TP2 33.3,13.95 33.3,29.16 34.21,30.08 39.78,30.08 40.85,31.15 40.85,31.6 v1(40.95,31.7)
SCLK: length 35.8
  Top Layer w0.2: ADC2.40 28.35,12.1 v1(29.2,12.95) ; ADC1.40 28.45,33.6 28.85,34 29.9,34 31.1,32.8 v1(31.1,32.35) ; v1(36.85,32.1) U2.16
  Bottom Layer w0.2: v1(29.2,12.95) 29.2,13.15 31.1,15.05 v1(31.1,32.35) 36.6,32.35 v1(36.85,32.1)
SLAVE_DOUT: length 25.3
  Top Layer w0.2: ADC2.43 28.05,13.6 30,15.55 30,28.6 v1(28.98,29.62) ; ADC1.41 27.9,34.1 v1(28.25,34.45)
  Bottom Layer w0.2: v1(28.25,34.45) 28,34.2 28,30.6 v1(28.98,29.62)
SRB1: length 9.9
  Top Layer w0.2: 11.45,23.1 11.45,23.4 11.7,23.65 13.02,23.65 13.7,24.33 13.7,25.57 16.43,28.3 ADC1.17
  Top Layer w0.4: Rsrb11.2 Csrb11.2
SRB2: length 11.2
  Top Layer w0.2: 11.45,24.2 11.44,24.22 11.44,24.5 11.71,24.77 13.05,24.77 13.38,25.1 13.38,25.7 17.22,29.55 17.8,29.55 18.05,29.3 ADC1.18
  Top Layer w0.4: Csrb12.1 Rsrb12.2
SRB11: length 9.9
  Top Layer w0.2: ADC2.17 16.44,6.8 13.7,4.07 13.7,2.83 13.02,2.15 11.7,2.15 11.45,1.9 11.45,1.6
  Top Layer w0.4: Csrb21.2 Rsrb21.2
SRB21: length 11.2
  Top Layer w0.2: ADC2.18 18.05,7.8 17.8,8.05 17.22,8.05 13.38,4.2 13.38,3.6 13,3.22 11.67,3.22 11.45,3 11.45,2.7
  Top Layer w0.4: Csrb22.1 Rsrb22.2
START: length 33
  Top Layer w0.2: 33.65,30.45 33.65,30.3 33.6,30.25 ; 33.6,30.25 33.6,29 31.1,26.5 31.1,12.6 31.3,12.4 ; 33.6,30.25 33,29.65 32,29.65 30.3,31.35 30.3,31.95 29.65,32.6 ADC1.38 ; ADC2.38 30.15,11.1 v1(30.25,11)
  Bottom Layer w0.2: v1(30.25,11) 30.25,11.35 v1(31.3,12.4)
USB_5V: length 1.6
  Top Layer w0.54: F2.2 35.65,26.3 RL1.2
  vias: v1(34.65,19.6) v1(35.3,19.9) v1(35.3,19.25) v1(36,19.9) v1(36.9,24.7) v1(36.9,24.1) v1(37.5,24.7) v1(37.5,24.1)
USB_5V_IN: length 1.4
  Top Layer w0.55: USB1.11 v1(38.65,25.75) ; USB1.2 v1(38.65,20.95)
  vias: v1(38.1,26.01)
VREFP: length 3.1
  Top Layer w0.28: ADC1.24 21.05,27 20.7,26.65
  Top Layer w0.8: C17.2 C18.2
VREFP1: length 3.2
  Top Layer w0.28: C32.2 21.05,5.4 ADC2.24
  Top Layer w0.8: C38.2 C32.2
VSYS:
  vias: v1(34.63,17.95) v1(34.63,16.65) v1(34.98,17.3) v1(35.33,17.95) v1(35.33,16.65) v1(35.68,17.3) v1(36.03,17.95) v1(36.03,16.65) v1(39.85,16.45) v1(39.85,15.5) v1(39.85,14.55) v1(40.5,16.45) v1(40.5,15.5) v1(40.5,14.55)
$1N289254: length 1.5
  Top Layer w0.25: 31.3,34.25 31.6,34.25 32.1,33.75 32.55,33.75
$1N290224: length 3.2
  Top Layer w0.2: Rb1.2 C234.1 ; 40.2,9.2 40.2,8.85 39.7,8.35 39.7,7.67 39.92,7.45 40.22,7.45
$1N290773: length 1.2
  Top Layer w0.3: 38.25,22.23 38.38,22.1 USB1.4
$1N290774: length 1.2
  Top Layer w0.3: USB1.10 38.38,25.1 38.25,24.97
$1N300888: length 1
  Top Layer w0.4: 34.62,24.6 34.62,24.6 RA1.1
$1N327432: length 1.2
  Top Layer w0.2: RL2.2 31.08,39.93 31.55,40.4
$1N332647: length 1
  Top Layer w0.54: 36.55,28.55 35.95,28.55 RL1.1
$1N370342: length 1.2
  Top Layer w0.2: Rb3.2 29.84,6.66 29.9,6.66
$1N381078: length 1
  Top Layer w0.2: U15.4 30.4,6.95 29.95,7.4 29.95,7.45
$1N381086: length 0.8
  Top Layer w0.2: 30.9,6.66 30.9,7.35 30.8,7.45
$1N397177: length 1.9
  Top Layer w0.2: Rb6.2 31.6,7.8 ; Rb7.1 31.6,7.4 31.4,7.2 U15.2
$2N2542: length 2.9
  Top Layer w0.28: ADC2.55 22.05,19 21.7,19.35
  Top Layer w0.8: C35.1 C34.1
$2N2551: length 1.8
  Top Layer w0.28: ADC2.30 24.05,5.2 C30.2
$2N2552: length 1.9
  Top Layer w0.28: 22,4.95 22.05,5 ADC2.26
$2N2553: length 4.6
  Top Layer w0.28: 24.18,2.65 23.05,3.78 ADC2.28
$2N2574: length 1.8
  Top Layer w0.28: 23.9,26.54 24.05,26.69 ADC1.30
$2N2575: length 1.9
  Top Layer w0.28: 22,26.45 22.05,26.5 ADC1.26
$2N2577: length 4.7
  Top Layer w0.28: 24.18,24.15 24.08,24.15 23.05,25.18 ADC1.28
$2N2597: length 4.4
  Top Layer w0.28: ADC1.62 ADC1.63 18.05,40.73
  Top Layer w0.3: RBIAS1.1 Cbias4.1 16.47,40.85 RBIAS4.1 Cbias3.2
$2N2598: length 2.9
  Top Layer w0.28: 21.7,40.85 22.05,40.5 ADC1.55
  Top Layer w0.8: C23.1 C22.1

## Copper pours and planes (outline as drawn; the poured copper is in the pictures)
3V3 on Top Layer: 39.53,4.74 44.33,4.74 44.33,3.11 39.53,3.11
3V3 on Top Layer: 38.47,4.49 38.49,4.59 38.55,4.67 38.63,4.72 38.72,4.74 39.9,4.74 40,4.72 40.08,4.67 40.13,4.59 40.15,4.49 40.15,3.36 40.13,3.26 40.08,3.18 40,3.12 39.9,3.11 38.72,3.11 38.63,3.12 38.55,3.18 38.49,3.26 38.47,3.36
